# EasyEDA Pro project 智能视觉母版_2024.eprj, board PCB1 (continued)
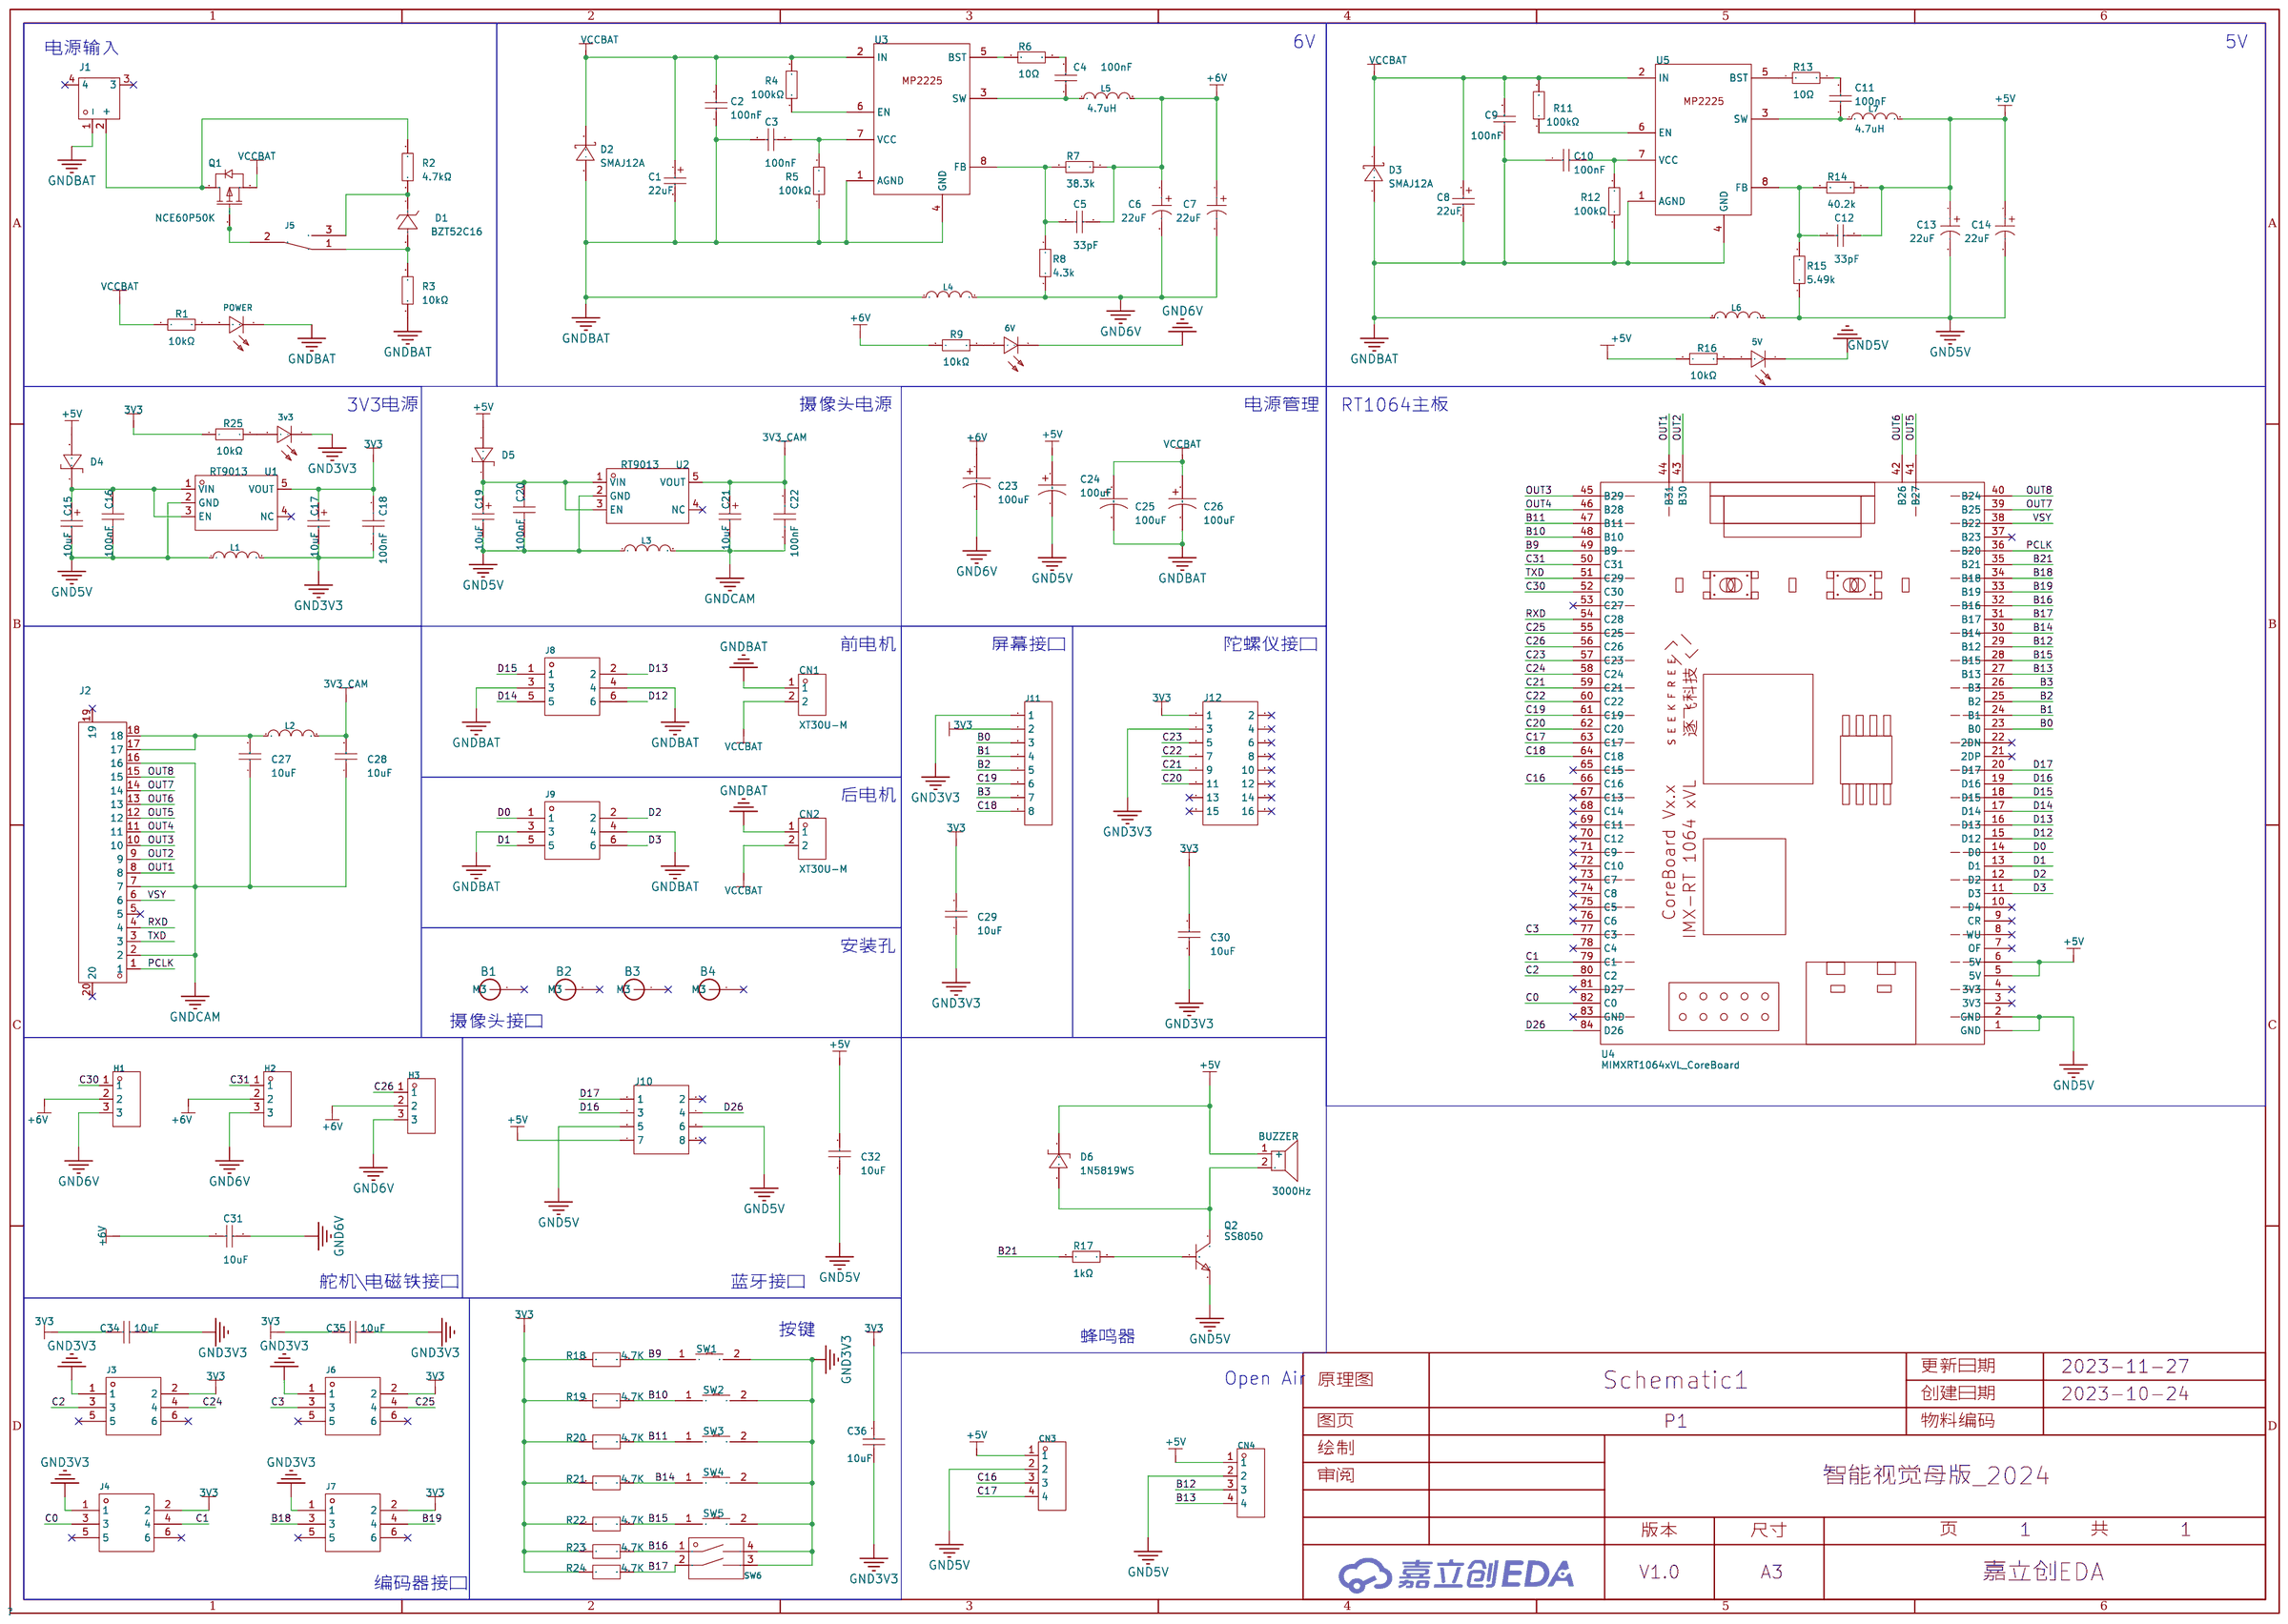
[diagram p0: schematic sheet]
## Routing (per net, layer and track width the routed paths; a pad name or vN(x,y) marks a point on that pad's centre or on a via; arc(x,y) is an arc through that point)
3V3: length 305.6
  Top Layer w0.152: v1(80.65,53.47) 80.65,51.67 C30.2 ; v1(75.82,67.31) 74.55,68.58 74.55,81.28 74.29,81.53 J3.2
  Top Layer w0.381: C29.2 34.56,36.43 v1(33.02,37.97) 32.13,37.97 31.75,37.59 31.75,28.83 37.97,22.61 37.97,11.83 C34.2 37.08,10.91 37.08,6.82 35.05,4.79 35.05,1.52 35.94,0.63 68.45,0.63 69.6,1.78 69.6,5.55 J4.2 ; R25.1 16.64,43.55 C17.1 ; J11.2 38.3,35.81 76.71,35.81 77.22,36.32 77.22,49.66 79.1,51.55 C30.2 84.24,51.55 J12.1 ; C17.1 16.01,45.21 v1(20.32,45.21) ; C17.1 13.79,42.99 C18.2 12.12,43.24 U1.5 ; J3.2 72.9,81.53 64.64,73.28 C35.2 58.93,75.53 58.93,80.26 J6.2
  Top Layer w0.508: J11.2 37.39,36.43 C29.2
  Bottom Layer w0.152: v1(80.65,53.47) 80.65,62.48 v1(75.82,67.31)
  Bottom Layer w0.381: R19.2 89.65,4.29 86.7,7.24 ; R21.2 88.65,8.01 88.65,7.36 88.53,7.24 86.7,7.24 ; R21.2 89.66,9.03 89.66,14.91 R20.2 89.65,19.06 85.35,23.36 R24.2 83.42,23.38 80.77,23.38 ; R21.2 90.48,8.64 91.88,7.24 96.01,7.24 96.52,7.75 R18.2 ; v1(20.32,45.21) 25.78,45.21 v1(33.02,37.97) ; 86.7,7.24 82.29,7.24 R22.2 80.41,9.12 80.41,14.99 C36.2 79.9,15.49 77.34,15.49 76.58,14.73 74.93,14.73 68.33,8.13 J4.2
3V3_CAM: length 46.7
  Top Layer w0.381: v1(18.67,75.31) 19.05,74.93 50.13,74.93 C21.1 51.32,72.5 C22.2 49.48,72.81 U2.5
  Top Layer w0.508: C28.2 16.06,77.12 v1(15.08,78.1) L2.2
  Bottom Layer w0.381: v1(18.67,75.31) 17.14,76.83 17.14,77.72 16.77,78.1 v1(15.08,78.1)
+5V: length 171.3
  Top Layer w0.381: L7.2 17.06,49.48 20.38,49.48 ; R16.1 25.41,57.92 27.69,60.2 33.78,60.2 34.54,59.44 C32.2 ; R16.1 24.59,50.96 23.11,49.48 20.38,49.48 ; R16.1 26.26,51.82 27.69,51.82 28.07,51.44 28.07,45.85 26.8,44.58 23.24,44.58 22.39,43.73 D6.1 23.5,41.82 23.5,37.51 BUZZER.1 ; C32.2 35.17,57.77 36.96,59.56 41.81,59.56 U4.5 U4.6 45.95,59.79 46.35,60.2 v1(46.35,65.79) 44.84,67.3 CN4.1 34.8,68.25 34.8,69.85 35.78,70.83 D5.2 ; C32.2 32.16,57.77 J10.7 ; D4.2 2.77,40.3 5.23,37.85 9.81,37.85 C24.1 15.24,34.16 18.54,37.47 v1(19.18,37.47) ; 20.38,49.48 20.95,50.05 R14.1 22.54,52.2 C12.1
  Bottom Layer w0.381: v1(46.35,65.79) 67.13,65.79 71.94,70.59 87.91,70.59 89.27,69.22 CN3.1 ; v1(19.18,37.47) 19.69,36.96 BUZZER.1
+6V: length 97.7
  Top Layer w0.381: v1(24,55.12) 24,57.4 25.78,59.18 25.78,63.37 25.15,64.01 C7.1 ; C7.1 C6.1 19.44,65.4 R7.1 19.33,67.21 17.57,67.21 15.49,65.13 ; C7.1 23.5,65.22 22.73,65.98 C5.1 ; C23.1 2.82,34.7 4.19,36.07 v1(10.67,36.07)
  Top Layer w0.508: H1.2 6.6,80.19 6.6,82.68 4.95,84.33 H3.2 ; H1.2 8.2,75.44 9.72,75.44 C31.2 15.11,74.17 17.4,71.88 18.45,71.88 ; H1.2 H2.2 ; C5.1 23.26,67.94 24,67.94 24.51,68.45 24.51,69.72 23.5,70.74 19.6,70.74 18.45,71.88 ; 18.45,71.88 R9.1
  Bottom Layer w0.381: v1(10.67,36.07) 10.67,37.08 24,50.42 v1(24,55.12)
GND3V3: length 309.3
  Top Layer w0.152: v1(75.44,66.42) 73.28,68.58 J3.1
  Top Layer w0.381: J4.1 67.35,4.28 66.42,3.35 v1(66.42,2.87) 66.42,1.52 66.04,1.14 38.1,1.14 37.08,2.16 37.08,4.28 37.17,4.28 38.35,5.46 38.35,9.4 39.99,11.03 C34.1 39.99,12.34 38.74,13.59 38.74,22.99 32.77,28.96 v1(32.77,34.8) ; L1.2 11.81,39.37 12.32,39.88 12.32,41.54 C18.1 13.91,41.59 C17.2 15.97,41.15 3v3.1 ; J11.1 38.63,32.95 76.76,32.95 78.1,34.29 78.1,48.77 v1(78.88,49.55) C30.1 83.73,49.55 J12.3 ; J6.1 57.66,74.8 C35.1 60.96,71.5 65.79,71.5 J3.1 ; SW5.2 v1(83.79,4.64) 90.99,4.64 SW2.2 95.63,2.67 96.52,3.56 SW1.2 92.96,8.45 SW4.2 SW3.2
  Top Layer w0.508: v1(32.77,34.8) 33.13,34.43 C29.1 37.14,34.43 J11.1 ; 3v3.1 v1(18.88,40)
  Bottom Layer w0.152: v1(75.44,66.42) 78.99,62.86 78.99,49.66 v1(78.88,49.55)
  Bottom Layer w0.381: C36.1 80.38,17.02 78.64,17.02 ; v1(66.42,2.87) 66.42,7.24 74.68,15.49 76.33,15.49 77.85,17.02 78.64,17.02 ; 78.64,17.02 78.99,17.37 78.99,25.43 80.23,26.67 SW6.4 SW6.3 ; v1(83.79,4.64) 83.79,4.29 81.91,2.41 70.61,2.41 68.75,4.28 J4.1
  Bottom Layer w0.508: v1(32.77,34.8) 32.77,36.45 29.21,40 v1(18.88,40)
GND5V: length 161
  Top Layer w0.381: U1.2 7.5,42.29 C16.1 ; v1(19.05,50.29) 20.19,51.44 20.19,53.09 R15.1 ; v1(11.05,40.51) 8.62,40.51 7.48,39.37 6.68,40.17 C16.1 ; C20.1 44,70.72 C19.2 ; C20.1 45.14,71.86 U2.2 ; C20.1 44.45,69.09 44.7,68.83 L3.1 48.47,66.56 v1(48.47,64.87) ; C15.2 6.05,40.84 C16.1 ; 29.46,55.39 34.16,55.39 C32.1 35.96,55.77 37.72,57.53 v1(37.72,58.29) ; v1(15.24,35.81) 12.7,35.81 10.92,37.59 v1(10.92,38.48)
  Top Layer w0.508: C24.2 17.91,34.16 20.19,36.45 20.19,43.86 C14.2 ; L6.2 v1(19.08,46.78) C13.2 C14.2 ; C14.2 24.94,46.78 ; 24.94,46.78 25.36,47.2 5V.1 ; 24.94,46.78 26.5,46.78 v1(26.92,46.36) ; v1(29.59,44.45) 30.14,44.45 30.84,43.75
  Bottom Layer w0.381: v1(15.24,35.81) 16.89,34.16 C24.2 ; v1(19.05,50.29) 19.05,46.81 v1(19.08,46.78) ; 29.46,55.39 26.92,52.85 v1(26.92,46.36) ; CN3.2 86.77,68.55 85.22,70.1 72.14,70.1 66.9,64.87 v1(49.1,64.87) v1(48.47,64.87) U4.2 U4.1 38.96,64.87 37.72,63.63 ; v1(11.05,40.51) 11.48,40.09 11.48,39.55 10.92,38.99 v1(10.92,38.48) ; v1(37.72,58.29) 37.72,63.63 ; 37.72,63.63 35.18,63.63 33.25,65.55 CN4.2
  Bottom Layer w0.508: v1(26.92,46.36) 28.83,44.45 v1(29.59,44.45)
GND6V: length 100.7
  Top Layer w0.381: L4.2 19.79,62.35 C6.2 ; C6.2 C7.2 ; C6.2 18.54,59.02 v1(18.54,56.52) ; 23.41,71.99 25.53,69.86 25.53,67.18 v1(24.26,65.91) ; C31.1 10.26,72.9 14.86,72.9 17.65,70.1 19.88,70.1 R8.1 v1(20.89,69.98) ; C23.2 9.27,34.16 v1(9.91,34.8)
  Top Layer w0.508: H2.3 0.55,79.93 0.55,75.06 1.44,74.17 C31.1 ; H2.3 1.78,84.07 H3.3 ; H2.3 H1.3
  Bottom Layer w0.381: v1(18.54,56.52) 9.91,47.88 v1(9.91,34.8) ; v1(20.89,69.98) 21.27,70.36 23.88,70.36 24.26,69.98 v1(24.26,65.91) 23.37,65.02 20.19,65.02 19.18,64.01 v1(19.18,62.36)
GNDBAT: length 285.1
  Top Layer w0.381: U5.4 7.94,53.92 7.75,53.72 ; v1(24.01,6.6) 33.02,6.6 v1(34.93,8.51) ; v1(10.54,69.6) 10.82,69.32 U3.1 ; v1(10.54,54.99) 10.86,54.67 U5.1 ; J8.4 J8.3 ; v1(6.73,52.07) 6.73,51.11 D3.2 ; J9.4 J9.3 ; v1(8.38,69.22) 8.38,68.88 U3.4 ; L4.1 15.8,61.84 14.1,61.84 13.99,61.95 C3.2 12.1,62.04 v1(11.2,62.04) C2.1 ; v1(6.48,66.8) D2.2
  Top Layer w0.508: v1(26.8,61.72) 26.8,69.85 v1(29.84,72.9) ; 34.67,47.5 34.29,47.88 v1(32.64,47.88) ; 11.93,47.18 C9.1 10.16,46.37 v1(9,45.21) ; 11.93,47.18 C10.1 ; 11.93,47.18 13.66,47.18 R12.1 15.3,47.13 L6.1 ; v1(54.86,12.06) v1(54.86,16) ; v1(53.97,12.06) v1(53.97,16)
  Top Layer w0.762: D3.2 5.62,50 C8.2 ; v1(2.77,62.48) C1.2 5.75,64.48 D2.2 ; POWER.1 32.63,14.01 28.28,9.65 25.53,9.65 24.01,8.13 v1(24.01,6.6)
  Bottom Layer w0.152: v1(39.88,48.13) 38.74,49.28 38.74,49.78 37.97,50.55 v1(36.96,50.55) ; v1(39.37,43.18) v1(39.37,45.11) v1(39.37,46.48)
  Bottom Layer w0.381: v1(10.54,69.6) 10.29,69.85 8.76,69.85 8.38,69.47 v1(8.38,69.22) 6.48,67.31 v1(6.48,66.8) ; v1(10.54,54.99) 8,54.99 7.75,54.74 7.75,53.69 v1(7.78,53.66) 6.73,52.62 v1(6.73,52.07) 5.08,50.42 5.08,45.85 v1(5.72,45.21) ; v1(34.93,8.51) 54.86,8.51 55.37,8 J9.4
  Bottom Layer w0.508: v1(54.48,56.77) v1(54.48,54.48) ; v1(89.41,74.42) v1(83.95,74.42) ; v1(69.98,73.79) 68.45,73.79 v1(67.56,74.68) ; J8.3 44.83,78.99 44.83,76.96 43.94,76.07 35.46,76.07 CN1.1 32.41,78.13 30.61,76.33 30.61,73.66 v1(29.84,72.9) ; v1(39.62,56.64) v1(39.62,54.36) ; v1(56.42,36.96) v1(56.42,34.27) v1(56.42,31.88) 56.42,30.06 v1(60.78,25.71) 61.21,25.27 63.37,25.27 v1(63.88,25.78) ; v1(26.8,61.72) 24.64,59.56 11.41,59.56 v1(10.66,60.31) ; v1(45.72,11.18) 44.96,11.94 v1(42.42,11.94) ; v1(55.6,51.82) 55.6,49.81 v1(55.63,49.78) ; v1(53.85,54.48) v1(53.85,56.77) 53.85,57.66 v1(48.39,63.12) 47.88,63.63 v1(43.31,63.63) ; v1(55.12,46.61) v1(55.12,44.83) ; v1(55.75,31.88) v1(55.75,34.29) v1(55.75,36.96) ; v1(44.96,14.99) 48.9,14.99 v1(50.29,16.38) ; v1(55.86,46.61) v1(55.86,44.83) ; v1(20.98,34.8) v1(20.32,34.8) 19.59,34.8 17.14,37.25 v1(17.14,37.97) ; v1(55.19,56.77) v1(55.19,54.48) ; v1(63.63,85.6) v1(63.63,83.06) ; v1(64.26,11.56) 65.53,11.56 v1(66.8,12.83) ; v1(70.74,74.3) v1(73.91,74.3) ; v1(64.39,83.06) v1(64.39,85.6) ; v1(45.47,2.41) v1(45.47,5.59) ; v1(54.74,51.82) v1(54.74,49.78)
  Bottom Layer w0.762: 6.6,59.18 4.57,59.18 2.77,60.98 v1(2.77,62.48) ; 6.6,59.18 5.46,58.04 5.46,52.58 5.97,52.07 v1(6.73,52.07) ; 6.6,59.18 v1(9.53,59.18) v1(10.14,59.8) v1(10.66,60.31) 11.18,60.83 11.18,61.98
  vias: v1(5.59,17.27) v1(5.59,11.56) v1(5.72,15.24) v1(5.72,6.22) v1(6.23,11.56) v1(6.38,45.21) v1(6.41,17.27) v1(6.43,6.22) v1(6.48,15.24) v1(6.79,11.56) v1(7.04,45.21) v1(7.12,15.24) v1(7.06,6.22) v1(7.19,17.27) v1(7.41,11.56) v1(7.68,45.21) v1(7.68,6.22) v1(7.77,15.24) v1(7.87,17.27) v1(8.34,45.21) v1(10.39,6.22) v1(10.98,6.22) v1(14.52,2.62) v1(14.48,1.91) v1(15.24,2.54) v1(15.3,1.91) v1(17.4,1.27) v1(18.03,1.27) v1(19.56,4.7) v1(19.56,3.94) v1(19.56,2.29) v1(20.25,4.7) v1(20.3,3.94) v1(20.31,2.29) v1(22.73,6.6) v1(23.39,6.6) v1(46.24,2.41) v1(47.04,2.39) v1(47.78,2.39) v1(50.29,17.67) v1(52.45,2.29) v1(53.77,2.29) v1(54.86,2.29) v1(55.65,2.29) v1(56.54,2.29) v1(61.59,11.68) v1(62.29,11.68) v1(63.25,11.68) v1(64.58,25.78) v1(65.28,25.78) v1(75.82,6.1) v1(75.82,5.06) v1(75.82,3.73) v1(93.6,25.61) v1(93.6,24.68) v1(93.6,23.74) v1(93.6,22.9) v1(93.6,22.08) v1(93.6,21.21) v1(93.6,20.45) v1(96.27,70.65) v1(96.27,69.22) v1(96.27,68.14) v1(96.27,67.13) v1(96.27,66.31) v1(96.27,65.41) v1(96.27,64.52) v1(96.39,46.31) v1(96.39,45.59) v1(96.39,44.77) v1(96.39,43.84) v1(96.39,43.1) v1(96.39,42.2) v1(96.39,41.41) v1(96.39,40.64) v1(96.39,39.88) v1(96.39,39.12)
GNDCAM: length 67.8
  Top Layer w0.152: J2.2 26.42,80.76 26.42,81.66 26.03,82.04 24.38,82.04 23.91,81.56 J2.7 23.88,80.78 23.88,81.66 23.5,82.04 19.99,82.04 19.41,81.45 J2.16
  Top Layer w0.381: 17.14,75.31 14.73,75.31 14.06,75.98 C28.1 ; 17.14,75.31 19.41,77.57 J2.16 ; 17.14,75.31 18.03,74.42 37.34,74.42 v1(39.75,72.01) ; L3.2 v1(49.13,69.84) 49.78,70.49 C22.1 51.57,71.1 C21.2
  Top Layer w0.508: C27.1 12.57,82.12 12.57,77.6 13.33,76.83 C28.1
  Bottom Layer w0.381: v1(39.75,72.01) 45.21,72.01 47.24,69.98 49,69.98 v1(49.13,69.84)
VCCBAT: length 106.7
  Top Layer w0.381: U5.2 10.21,53.24 9.93,52.96 7.11,52.96 6.48,53.59 6.48,55.06 D3.1 ; D2.1 6.48,68.71 7.74,67.44 9.91,67.44 10.17,67.7 U3.2
  Top Layer w0.508: C9.2 10.11,48.63 R11.2 5.58,48.63 4.57,47.62 v1(3.58,47.62) ; C1.1 2.77,71.99 v1(3.3,72.52) 5.59,72.52 v1(6.35,73.28)
  Top Layer w0.762: 0.76,61.87 0.76,68.83 2.33,70.4 C1.1 5.75,70.4 D2.1 ; 0.76,61.87 0.76,57.93 C8.1 ; 0.76,61.87 1.67,60.96 4.83,60.96 7.24,63.37 8.41,63.37 R4.2 10.25,63.47 C2.2 ; C8.1 5.62,55.92 D3.1 ; C8.1 1.94,55.92 0.89,54.86 0.89,48.64 v1(1.91,47.62) ; 13.97,26.92 19.18,32.13 26.54,32.13 27.43,31.25 27.43,27.31 28.44,26.29 30.86,26.29 v1(32.25,24.9) v1(32.77,24.38) v1(32.77,23.65) 32.77,16.95 R1.1 ; 13.97,26.92 v1(13.97,26.67) ; 13.97,26.92 13.46,26.92 v1(13.21,26.67) ; 13.97,26.92 14.61,26.92 v1(14.86,26.67)
  vias: v1(1.91,46.74) v1(2.03,38.1) v1(2.03,27.69) v1(2.03,26.92) v1(2.03,25.15) v1(2.08,37.27) v1(2.71,47.62) v1(2.74,46.74) v1(2.79,38.1) v1(2.83,37.27) v1(2.81,27.69) v1(2.89,26.92) v1(2.86,25.15) v1(3.53,27.69) v1(3.56,46.74) v1(3.71,38.06) v1(3.72,37.27) v1(3.72,26.92) v1(3.69,25.15) v1(6.86,72.77) v1(27.31,7.49) v1(28,7.49) v1(28.74,7.49) v1(29.5,7.49) v1(29.84,9.65) v1(30.26,7.49) v1(30.61,9.65) v1(30.86,22.48) v1(30.86,21.72) v1(30.86,20.84) v1(30.86,19.91) v1(30.86,19.18) v1(30.86,18.42) v1(30.93,7.49) v1(31.5,9.65)
B0: length 5.4
  Top Layer w0.152: J11.3 39.72,36.93 U4.23
B1: length 9
  Top Layer w0.152: U4.24 43.28,38.23 40.97,38.23 J11.4
B2: length 12
  Bottom Layer w0.152: J11.5 40.26,41.47 40.26,35.56 41.43,34.39 U4.25
B3: length 18.7
  Bottom Layer w0.152: U4.26 43.84,34.39 43.31,34.92 43.31,39.88 42.42,40.77 41.66,40.77 40.77,41.66 40.77,46.05 J11.7
B9: length 34.5
  Top Layer w0.152: SW1.1 96.52,15.11 94.74,16.89 v1(88.52,16.89) ; v1(80.9,17.65) 80.14,17.65 79.63,18.16 79.63,20.07 77.85,21.84 77.09,21.84 v1(76.71,21.46)
  Top Layer w0.381: v1(96.52,11.05) SW1.1
  Bottom Layer w0.152: v1(76.71,21.46) 76.71,21.21 76.07,20.57 73.63,20.57 U4.49 ; v1(80.9,17.65) 87.76,17.65 v1(88.52,16.89)
  Bottom Layer w0.381: R18.1 v1(96.52,11.05)
B10: length 26.7
  Top Layer w0.381: v1(86.61,2.67) SW2.1 80.14,2.67 77.72,5.08 77.72,16.49 U4.48
  Bottom Layer w0.381: R19.1 88.02,2.67 v1(86.61,2.67)
B11: length 18.3
  Top Layer w0.381: U4.47 73.61,20.24 75.89,20.24 81.15,14.99 SW3.1 86.67,14.99 v1(86.74,14.91)
  Bottom Layer w0.381: R20.1 v1(86.74,14.91)
B12: length 47.9
  Top Layer w0.152: CN4.3 30.75,67.29 37.21,60.83 39.12,60.83
  Bottom Layer w0.152: U4.29 40.14,29.31 36.32,33.13 36.32,54.29 40,57.97 40,60.07 v1(39.24,60.83)
B13: length 51.4
  Top Layer w0.152: CN4.4 34.59,60.96 35.56,60.96 v1(36.32,60.2)
  Bottom Layer w0.152: U4.27 42.57,31.85 43.05,31.37 43.05,28.7 42.67,28.32 40.77,28.32 35.94,33.15 35.94,54.27 36.32,54.65 v1(36.32,60.2)
B14: length 56.2
  Top Layer w0.152: v1(80.01,6.6) 82.04,8.64 v1(86.61,8.64) ; U4.30 45.24,29.97 v1(47.12,29.97) ; v1(73.15,11.43) 73.15,12.06 71.09,14.12 66.52,14.12 60.96,19.69 60.96,20.31 53.33,27.94 49.4,27.94 v1(49.02,27.56)
  Top Layer w0.381: 85.08,8.64 SW4.1
  Bottom Layer w0.152: v1(80.01,6.6) 77.98,6.6 v1(73.15,11.43) ; v1(49.02,27.56) 48.31,27.56 48.16,27.71 48.16,29.44 47.62,29.97 v1(47.12,29.97) ; R21.1 v1(86.61,8.64)
B15: length 51.7
  Top Layer w0.152: v1(78.87,13.59) 80.45,13.59 SW5.1 81.47,12.57 82.04,12.57 82.55,12.06 82.55,11.3 v1(82.04,10.79) ; v1(55.88,26.29) 55.88,26.16 67.44,14.6 71.25,14.6 72.26,13.59 v1(75.18,13.59) ; U4.28 49.81,31.85 v1(50.55,31.11)
  Bottom Layer w0.152: v1(82.04,10.79) 81.53,10.29 R22.1 ; v1(50.55,31.11) 50.55,26.92 51.18,26.29 v1(55.88,26.29) ; v1(78.87,13.59) v1(75.18,13.59)
B16: length 54
  Top Layer w0.152: SW6.1 80.77,20.19 78.23,22.73 71.5,22.73 71.25,22.48 71.25,18.16 70.99,17.91 69.34,17.91 68.71,17.27 67.06,17.27 62.48,21.84 61.73,21.84 54.49,29.08 v1(47.5,29.08)
  Bottom Layer w0.152: U4.32 45.57,25.78 46.48,25.78 46.86,26.16 46.86,28.45 v1(47.5,29.08)
  Bottom Layer w0.381: R23.1 SW6.1
B17: length 53.4
  Top Layer w0.152: U4.31 43.08,27.81 45.72,27.81 47.88,25.65 v1(47.88,24.51) ; v1(72.01,20.32) 72.38,20.69 75.97,20.69 79.9,16.76 81.03,16.76 SW6.2 ; v1(62.36,24.26) 62.36,23.24 v1(67.44,18.16)
  Bottom Layer w0.152: v1(47.88,24.51) 48.13,24.26 v1(62.36,24.26) ; v1(72.01,20.32) 69.72,20.32 67.56,18.16 v1(67.44,18.16)
  Bottom Layer w0.381: SW6.2 83.44,19.18 R24.1
B18: length 38.2
  Top Layer w0.152: U4.34 44.58,23.5 v1(43.69,22.61) ; v1(49.4,21.59) 49.4,7.75 44.32,2.67 41.24,2.67 39.62,4.28
  Bottom Layer w0.152: v1(43.69,22.61) 43.18,22.1 43.18,21.08 43.69,20.57 45.47,20.57 45.85,20.96 45.85,21.97 46.23,22.35 48.64,22.35 v1(49.4,21.59)
B19: length 35.8
  Top Layer w0.152: 39.62,6.82 48.77,15.96 48.77,26.03 46.74,28.07 41.4,28.07 40.77,27.43 40.77,26.16 42.04,24.89 U4.33
B21: length 40.5
  Top Layer w0.152: v1(39.24,36.58) 37.85,37.97 36.19,37.97 34.04,40.13 R17.1 ; v1(42.67,15.24) 40,15.24 39.5,15.75 39.5,23.24 38.86,23.88 38.86,30.61 v1(39.24,30.99)
  Bottom Layer w0.152: v1(39.24,36.58) v1(39.24,30.99) ; v1(42.67,15.24) 43.18,15.75 43.18,20.55 U4.35
C0: length 65.5
  Top Layer w0.152: J4.3 72.01,5.42 72.01,12.32 71.37,12.95 69.22,12.95 v1(68.58,13.59) ; v1(68.2,17.91) v1(68.2,26.8)
  Bottom Layer w0.152: v1(68.2,26.8) 68.2,53.21 70.99,56.01 73.15,56.01 73.79,56.64 73.79,61.06 U4.82 ; v1(68.58,13.59) 68.58,17.53 v1(68.2,17.91)
C1: length 61.8
  Top Layer w0.152: v1(61.85,27.31) 61.72,27.18 v1(61.72,22.61) ; J4.4 70.87,7.62 61.72,16.76 v1(61.72,17.53) ; v1(69.34,56.13) 70.61,57.4 70.61,58.8 71.6,59.79 U4.79
  Bottom Layer w0.152: v1(61.72,17.53) v1(61.72,22.61) ; v1(69.34,56.13) 61.85,48.64 v1(61.85,27.31)
C2: length 20.8
  Top Layer w0.152: J3.3 77.09,77.72 77.09,61.47 75.41,59.79 U4.80
C3: length 28.9
  Top Layer w0.152: v1(63.5,74.55) 63.5,75.69 J6.3 ; v1(66.93,59.31) 63.5,62.74 v1(63.5,68.96)
  Bottom Layer w0.152: U4.77 68.99,57.25 v1(66.93,59.31) ; v1(63.5,68.96) v1(63.5,74.55)
C16: length 29
  Top Layer w0.152: U4.66 76.58,43.54 76.58,53.21 84.27,60.91 CN3.3
C17: length 37.7
  Top Layer w0.152: v1(69.6,42.42) 69.6,51.94 71.12,53.47 76.07,53.47 81.77,59.17 CN3.4
  Bottom Layer w0.152: U4.63 71.02,39.47 69.6,40.89 v1(69.6,42.42)
C18: length 42.6
  Top Layer w0.152: U4.64 73.76,40.77 69.72,40.77 59.65,50.84 38.51,50.84 J11.8
C19: length 39.1
  Top Layer w0.152: J11.6 38.51,45.76 62.06,45.76 70.99,36.83 72.41,36.83 U4.61
C20: length 11.5
  Top Layer w0.152: v1(79.5,40.64) 82.3,40.64 84.07,38.86 J12.11
  Bottom Layer w0.152: v1(79.5,40.64) 75.79,36.93 U4.62
C21: length 17.3
  Bottom Layer w0.152: U4.59 73.63,33.27 76.96,33.27 79.38,35.69 79.38,38.7 82.07,41.4 J12.9
C22: length 14.9
  Bottom Layer w0.152: U4.60 77.7,34.39 79.12,35.81 79.12,38.81 J12.7
C23: length 23.5
  Top Layer w0.152: U4.57 72.52,31.37 73.28,30.61 75.82,30.61 78.74,33.53 78.74,40.97 J12.5
C24: length 75.6
  Top Layer w0.152: v1(78.49,31.88) 87.12,31.88 91.06,35.81 91.06,69.47 83.31,77.22 83.31,81.66 81.66,83.31 77.6,83.31 J3.4
  Bottom Layer w0.152: U4.58 78.46,31.85 v1(78.49,31.88)
C25: length 99
  Top Layer w0.152: J6.4 63.12,84.45 82.04,84.45 86.61,79.88 86.61,75.56 92.2,69.98 92.2,35.94 86.87,30.61 78.1,30.61 75.82,28.32 73.51,28.32 U4.55
C26: length 119.9
  Bottom Layer w0.152: U4.56 73.81,28.07 71.5,28.07 66.68,23.24 40.64,23.24 40.26,23.62 40.26,24.64 34.29,30.61 34.29,58.93 32.38,60.83 30.48,60.83 25.65,65.66 25.65,70.74 24.51,71.88 13.97,71.88 12.57,73.28 12.57,80.49 8.36,84.71 7.49,84.71
C30: length 127.7
  Bottom Layer w0.152: H1.1 5.02,73.19 6.59,71.63 24.38,71.63 25.27,70.74 25.27,65.66 30.48,60.45 32.38,60.45 33.91,58.93 33.91,30.48 39.88,24.51 39.88,14.22 40.51,13.59 61.47,13.59 70.87,22.99 73.81,22.99 U4.52
C31: length 129.4
  Bottom Layer w0.152: H2.1 6.48,71.37 24.13,71.37 24.89,70.61 24.89,65.66 30.48,60.07 32.26,60.07 33.55,58.78 33.55,30.45 39.5,24.51 39.5,13.84 40.13,13.21 61.59,13.21 71.06,22.67 74.1,22.67 75.06,21.72 U4.50
D0: length 52.5
  Top Layer w0.152: J9.1 50.93,6.18 50.93,26.03 v1(49.78,27.18) ; v1(49.78,49.78) 49.28,50.29 45.24,50.29 U4.14
  Bottom Layer w0.152: v1(49.78,27.18) v1(49.78,49.78)
D1: length 68.2
  Top Layer w0.152: v1(39.62,51.56) 40.26,51.56 40.64,51.18 49.83,51.18 50.47,51.82 v1(51.69,51.82) ; v1(53.34,27.18) 53.34,26.8 59.06,21.08 59.06,5.42 J9.5 ; U4.13 39.65,49.63 v1(39.24,50.04)
  Bottom Layer w0.152: v1(39.24,50.04) 39.24,51.18 v1(39.62,51.56) ; v1(53.34,27.18) 53.34,50.17 v1(51.69,51.82)
D2: length 51.6
  Top Layer w0.152: U4.12 44.6,52.2 v1(49.28,52.2) ; v1(51.18,27.18) 52.83,25.53 J9.2
  Bottom Layer w0.152: v1(49.28,52.2) 51.18,50.29 v1(51.18,27.18)
D3: length 57.9
  Top Layer w0.152: J9.6 57.91,21.21 52.45,26.67 v1(52.45,27.18) ; U4.11 42.04,52.32 43.05,53.34 v1(49.28,53.34)
  Bottom Layer w0.152: v1(49.28,53.34) 52.45,50.17 v1(52.45,27.18)
D12: length 45.9
  Top Layer w0.152: U4.15 43.33,48.39 46.23,48.39 46.35,48.51 v1(46.35,49.15) ; v1(46.35,58.04) 53.85,65.53 v1(53.85,68.83) ; J8.6 48.26,82.42 49.02,82.42 50.29,81.15 50.29,77.34 51.18,76.45
  Bottom Layer w0.152: v1(46.35,49.15) v1(46.35,58.04) ; v1(51.18,76.45) 53.85,73.79 v1(53.85,68.83)
D13: length 51.5
  Top Layer w0.152: J8.2 43.94,83.19 48.64,83.19 50.55,81.28 50.55,77.85 54.99,73.41 54.99,64.9 v1(48.13,58.04) ; U4.16 46.97,47.09 v1(48.13,48.26)
  Bottom Layer w0.152: v1(48.13,58.04) v1(48.13,48.26)
D14: length 51.5
  Top Layer w0.152: v1(50.16,76.2) 49.91,76.45 49.91,78.36 49.28,78.99 J8.5 ; v1(52.71,68.96) 52.71,65.66 v1(45.72,58.67) ; v1(44.32,43.31) 44.07,43.05 42.29,43.05 42.04,43.31 U4.17
  Bottom Layer w0.152: v1(45.72,58.67) 45.72,54.1 44.83,53.21 44.07,53.21 43.31,52.45 43.31,48.77 43.69,48.39 45.47,48.39 46.1,47.75 46.1,46.61 45.21,45.72 43.75,45.72 43.56,45.53 43.56,44.07 v1(44.32,43.31) ; v1(50.16,76.2) 52.71,73.66 v1(52.71,68.96)
D15: length 47.6
  Top Layer w0.152: J8.1 45.72,75.56 52.45,75.56 54.61,73.41 54.61,65.41 v1(47.24,58.04)
  Bottom Layer w0.152: U4.18 47.24,47.22 v1(47.24,58.04)
D16: length 16.2
  Top Layer w0.152: J10.3 36.19,48.66 36.19,45.72 36.45,45.47 38.23,45.47 41.68,42.01 U4.19
D17: length 19
  Top Layer w0.152: U4.20 44.58,41.66 43.56,40.64 40.89,40.64 38.61,42.93 36.58,42.93 32,47.5 J10.1
D26: length 51.7
  Top Layer w0.152: J10.4 30.59,53.97 37.34,53.97 39.24,55.88 66.17,55.88 69.72,59.44 69.72,61.34 72.01,63.63 73.81,63.63 U4.84
OUT1: length 147.9
  Top Layer w0.152: v1(26.03,75.82) 23.41,78.45 J2.8 ; U4.44 69.98,22.22 70.87,23.11 78.23,23.11 78.74,23.62 v1(78.74,26.16)
  Bottom Layer w0.152: v1(78.74,26.16) 78.74,28.45 80.65,30.35 86.85,30.35 92.58,36.09 92.58,69.17 90,71.76 69.77,71.76 67.1,69.09 67.06,69.09 65.02,67.06 45.97,67.06 43.89,69.14 30.41,69.14 26.03,73.51 v1(26.03,75.82)
OUT2: length 151
  Top Layer w0.152: J2.9 22.91,78.19 v1(25.27,75.82)
  Bottom Layer w0.152: v1(25.27,75.82) 25.27,73.91 30.35,68.83 43.81,68.83 45.85,66.8 65.17,66.8 69.87,71.5 89.89,71.5 92.33,69.07 92.33,36.2 86.87,30.73 80.62,30.73 78.16,28.27 78.16,19.61 76.2,17.65 74.29,17.65 73.79,17.15 73.79,16.38 72.9,15.49 70.36,15.49 69.98,15.88 U4.43
OUT3: length 146.9
  Top Layer w0.152: J2.10 22.41,77.92 v1(24.51,75.82)
  Bottom Layer w0.152: U4.45 72.52,17.4 73.15,18.03 76.2,18.03 77.6,19.43 77.6,28.07 80.65,31.11 86.87,31.11 92.07,36.32 92.07,68.96 89.79,71.25 69.98,71.25 65.28,66.55 45.72,66.55 43.69,68.58 30.23,68.58 24.51,74.3 v1(24.51,75.82)
OUT4: length 102.3
  Top Layer w0.152: v1(23.75,75.82) 21.91,77.66 J2.11 ; v1(39.75,28.32) 54.74,28.32 67.82,15.24 73.69,15.24 U4.46
  Bottom Layer w0.152: v1(23.75,75.82) 23.75,74.61 26.93,71.44 26.93,66.42 31.24,62.11 32.91,62.11 35.56,59.45 35.56,32.13 39.37,28.32 v1(39.75,28.32)
OUT5: length 76.5
  Top Layer w0.152: v1(47.24,24) 47.24,19.28 U4.41 ; J2.12 21.41,77.4 v1(22.99,75.82)
  Bottom Layer w0.152: 31.12,61.85 32.81,61.85 35.31,59.35 35.31,31.98 39.6,27.69 40.77,27.69 40.89,27.81 42.67,27.81 43.43,27.05 43.43,25.78 43.81,25.4 45.85,25.4 v1(47.24,24) ; 31.11,61.85 26.67,66.29 26.67,71.33 22.99,75.01 v1(22.99,75.82)
OUT6: length 78
  Top Layer w0.152: J2.13 20.91,77.14 v1(22.22,75.82) ; U4.42 45.95,17.78 43.94,17.78 43.05,18.67 43.05,25.25 42.9,25.4 v1(42.8,25.4)
  Bottom Layer w0.152: v1(22.22,75.82) 22.22,75.42 26.42,71.22 26.42,66.17 30.99,61.6 32.7,61.6 35.05,59.24 35.05,31.88 39.5,27.43 39.85,27.43 41.88,25.4 v1(42.8,25.4)
OUT7: length 74.8
  Top Layer w0.152: J2.14 20.41,76.88 v1(21.46,75.82) ; U4.39 41.05,16.61 39.88,17.78 39.88,26.54 v1(39.62,26.8)
  Bottom Layer w0.152: v1(21.46,75.82) 21.46,75.65 26.16,70.95 26.16,65.91 30.73,61.34 32.6,61.34 34.8,59.14 34.8,31.62 v1(39.62,26.8)
OUT8: length 76.9
  Top Layer w0.152: U4.40 43.28,17.91 41.02,17.91 40.77,18.16 v1(40.77,24.89) ; J2.15 19.91,76.61 v1(20.7,75.82)
  Bottom Layer w0.152: v1(20.7,75.82) 20.71,75.82 24.39,72.14 24.62,72.14 25.91,70.84 25.91,65.76 30.59,61.09 32.49,61.09 34.54,59.03 34.54,31.11 v1(40.77,24.89)
PCLK: length 70.3
  Top Layer w0.152: U4.36 44.58,22.1 45.72,23.24 45.72,26.03 v1(46.1,26.42) ; v1(29.84,71.75) 30.73,71.75 34.42,68.07 34.42,66.52 39.6,61.34 v1(40,61.34) ; J2.1 26.91,78 v1(29.08,75.82)
  Bottom Layer w0.152: v1(29.08,75.82) 29.08,72.52 v1(29.84,71.75) ; v1(40,61.34) 40.39,60.96 40.39,49.15 41.28,48.26 42.42,48.26 43.05,47.62 43.05,41.15 43.56,40.64 45.34,40.64 46.35,39.62 46.35,26.67 v1(46.1,26.42)
RXD: length 135.1
  Top Layer w0.152: v1(27.56,75.82) 25.41,77.97 J2.4 ; U4.54 75.46,27.18 78.49,27.18 79.88,28.58 v1(80.39,28.58)
  Bottom Layer w0.152: v1(80.39,28.58) 81.03,28.58 81.79,29.34 86.55,29.34 93.09,35.88 93.09,35.94 93.09,35.94 93.09,69.38 90.21,72.26 69.56,72.26 66.89,69.6 66.84,69.6 64.81,67.57 46.18,67.57 44.1,69.65 30.62,69.65 27.56,72.71 v1(27.56,75.82)
TXD: length 138.9
  Top Layer w0.152: U4.51 72.52,24.26 73.66,25.4 77.22,25.4 79.13,27.31 v1(79.5,27.31) ; J2.3 25.91,78.23 v1(28.32,75.82)
  Bottom Layer w0.152: v1(79.5,27.31) 80.21,28.01 80.82,28.01 81.89,29.08 86.66,29.08 93.35,35.77 93.35,69.49 90.32,72.52 69.45,72.52 66.78,69.85 66.74,69.85 64.74,67.85 46.26,67.85 44.21,69.9 44.15,69.9 44.14,69.9 30.72,69.9 28.32,72.31 v1(28.32,75.82)
VSY: length 170.9
  Top Layer w0.152: U4.38 46.35,20.93 46.35,24.64 v1(46.99,25.27) ; v1(81.28,29.72) 80.52,29.72 78.74,27.94 61.59,27.94 v1(59.31,25.65) ; v1(26.8,75.82) 24.41,78.21 J2.6
  Bottom Layer w0.152: v1(26.8,75.82) 26.8,73.11 30.51,69.4 43.99,69.4 46.08,67.31 64.92,67.31 66.95,69.34 66.99,69.34 69.66,72.01 90.04,72.01 90.05,72.01 90.1,72.01 92.84,69.28 92.84,35.98 86.57,29.72 v1(81.28,29.72) ; v1(59.31,25.65) 47.37,25.65 v1(46.99,25.27)
$1N2017: length 13
  Top Layer w0.762: D1.1 R2.1 23,14.74 23.5,15.24 23.5,20.7 24.13,21.34 25.65,21.34 25.91,21.59
$1N2018: length 8.1
  Top Layer w0.762: J5.1 22.72,12.19 D1.2 R3.1
$1N2019: length 9.1
  Top Layer w0.762: R2.2 20.45,24.16 Q1.3
$1N2020: length 19.1
  Top Layer w0.762: Q1.1 21.26,28.78 23.62,26.42 23.62,23.24 23.75,23.11 27.69,23.11 28.32,22.48 28.32,18.92 26.29,16.89 J5.2
$1N2023: length 1.8
  Top Layer w0.762: POWER.2 31.08,14.98 R1.2
$1N2720: length 9.8
  Top Layer w0.381: R11.1 8.38,46.74 7.87,46.23 v1(6.73,46.23) ; U5.6 9.56,50.71 v1(9.14,50.29)
  Bottom Layer w0.381: v1(6.73,46.23) 6.1,46.86 6.1,48.26 8.13,50.29 v1(9.14,50.29)
$1N2721: length 10.1
  Top Layer w0.381: L7.1 13.87,56.77 9.78,56.77 C11.1 9.08,55.18 9.53,54.74 9.53,53.95 U5.3
$1N2725: length 1.8
  Top Layer w0.381: R16.2 26.92,49.19 5V.2
$1N2726: length 5.4
  Top Layer w0.381: U5.7 10.21,50.75 11.94,49.02 11.94,48.59 13.67,48.59 R12.2
$1N2727: length 7.1
  Top Layer w0.381: R13.1 11.68,55.12 11.68,52.96 11.18,52.45 9.27,52.45 8.91,52.09 U5.5
$1N2728: length 1.7
  Top Layer w0.508: 9.08,57.47 10.75,57.47 10.8,57.51
$1N2730: length 16
  Top Layer w0.381: U5.8 11.24,51.49 12.7,52.96 17.27,52.96 18.03,52.2 R14.2 R15.2 20.71,55.12 22.22,55.12 22.73,54.61 C12.2
$1N3433: length 9.9
  Top Layer w0.381: L5.1 13.48,71.25 9.78,71.25 C4.1 9.08,69.89 9.52,69.46 U3.3
$1N3437: length 1.7
  Top Layer w0.508: R9.2 21.8,71.98 6V.2
$1N3439: length 8.2
  Top Layer w0.381: v1(7.24,61.21) 7.75,61.21 R4.1 ; v1(9.02,64.77) 9.52,65.27 U3.6
  Bottom Layer w0.381: v1(7.24,61.21) 6.98,61.47 6.98,64.01 7.75,64.77 v1(9.02,64.77)
$1N3441: length 5.9
  Top Layer w0.381: U3.7 10.17,65.17 10.95,64.39 11.81,64.39 12.19,64.01 C3.1 14.09,63.35 R5.2
$1N3443: length 14.8
  Top Layer w0.381: U3.8 12.53,67.69 17.65,67.69 19.05,69.09 R8.2 19.38,68.75 20.82,67.32 R7.2 21.24,67.32 C5.2
$1N3444: length 2
  Top Layer w0.381: R6.2 10.96,71.95 C4.2
$1N3445: length 6.8
  Top Layer w0.381: U3.5 8.87,66.52 9.27,66.93 10.94,66.93 10.97,66.9 11.43,67.37 11.43,70.08 R6.1
$1N3714: length 9.8
  Top Layer w0.381: U2.3 46.06,70.87 46.74,70.87 47.24,71.37 47.24,72.52 46.95,72.81 U2.1 45.78,72.57 C20.2 44.45,72.64 43.92,73.18 42.49,73.18 ; D5.1 42.49,73.18 ; 42.49,73.18 C19.1
$1N5546: length 9.3
  Top Layer w0.381: U1.3 9.08,41.34 9.27,41.53 9.27,42.8 8.83,43.24 U1.1 7.69,43.24 7.31,42.86 C16.2 6.3,43.24 4.8,43.24 4.7,43.34 D4.1
$1N5812: length 7.4
  Top Layer w0.508: 18.85,80.75 J2.18 17.62,80.75 L2.1 14.39,80.72 C27.2
$1N7643: length 10.9
  Top Layer w0.381: BUZZER.2 27.94,40.51 28.84,41.42 Q2.3 28.08,43.56 25.37,43.56 D6.2
$1N7645: length 1.9
  Top Layer w0.381: R17.2 30.84,40.49 Q2.1
$1N9389: length 1.8
  Top Layer w0.381: 3v3.2 18.41,42.08 R25.2

## Copper pours and planes (outline as drawn; the poured copper is in the pictures)
GNDBAT on Top Layer: 13.59,7.37 26.47,7.37 26.47,0.59 13.59,0.59
GNDBAT on Top Layer: -4.44,91.82 106.3,91.82 106.3,-4.7 -4.44,-4.7
GNDBAT on Bottom Layer: 5.08,20.32 9.4,20.32 9.4,45.72 5.08,45.72
GNDBAT on Bottom Layer: -4.44,91.82 106.3,91.82 106.3,-4.7 -4.44,-4.7
GNDBAT on Bottom Layer: 5.08,20.32 5.08,24.64 17.32,24.64 17.32,19.57 14.42,19.57 14.42,22.86 9.53,22.86 9.53,20.38 9.47,20.32
GNDBAT on Bottom Layer: 5.08,23.37 9.4,23.37 9.4,7.49 19.69,7.49 19.69,0.63 13.09,0.63 13.08,0.63 13.08,5.59 5.21,5.59 5.08,5.72
VCCBAT on Top Layer: 10.97,19.75 10.97,25.08 12.74,25.08 12.74,27.18 15.47,27.18 15.47,23.13 15.49,23.11 13.66,23.11 13.66,19.77 13.64,19.75
VCCBAT on Top Layer: 1.4,23.11 4.06,23.11 4.06,20.45 13.63,20.45 13.63,18.29 1.52,18.29 1.4,18.41
VCCBAT on Bottom Layer: 28.96,25.91 33.78,25.91 33.78,0.95 26.53,0.95 26.53,8.22 28.96,8.22
VCCBAT on Bottom Layer: 0.76,68.2 0.76,85.85 0.89,85.98 37.97,85.98 37.97,80.45 15.37,80.45 15.37,68.31 15.49,68.18 0.78,68.18
VCCBAT on Bottom Layer: 1.4,18.03 4.61,18.03 4.61,48.13 1.27,48.13 1.27,18.16
$1N2019 on Top Layer: 13.65,15.74 19.43,15.74 19.43,18.24 22.14,18.24 22.14,15.36 19.44,15.36 19.43,15.37 19.43,9.78 13.59,9.78 13.59,15.68

Small or netless copper shapes (teardrops, artwork), in the pictures only: 495 on Top Layer, 221 on Bottom Layer

## Text on the board
Top Layer: HZCU | 2024 | DEBUG
Top Silkscreen Layer: ON | +
